# EAGLE board Resistor_Resistor (EAGLE 8.3.0), part 12 of 32
## Placement (x,y rotation side) (continued)
R14257  10K  [0201]  111.91,35.41 0 top
R14258  10K  [0201]  111.91,36.02 0 top
R14259  10K  [0201]  111.91,36.63 0 top
R14260  10K  [0201]  111.91,37.24 0 top
R14261  10K  [0201]  111.91,37.85 0 top
R14262  10K  [0201]  111.91,38.46 0 top
R14263  10K  [0201]  111.91,39.07 0 top
R14264  10K  [0201]  111.91,39.67 0 top
R14265  10K  [0201]  111.91,40.28 0 top
R14266  10K  [0201]  111.91,40.89 0 top
R14267  10K  [0201]  111.91,41.5 0 top
R14268  10K  [0201]  111.91,42.11 0 top
R14269  10K  [0201]  111.91,42.72 0 top
R14270  10K  [0201]  111.91,43.33 0 top
R14271  10K  [0201]  111.91,43.94 0 top
R14272  10K  [0201]  111.91,44.55 0 top
R14273  10K  [0201]  111.91,45.16 0 top
R14274  10K  [0201]  111.91,45.77 0 top
R14275  10K  [0201]  111.91,46.38 0 top
R14276  10K  [0201]  111.91,46.99 0 top
R14277  10K  [0201]  111.91,47.6 0 top
R14278  10K  [0201]  111.91,48.21 0 top
R14279  10K  [0201]  111.91,48.82 0 top
R14280  10K  [0201]  111.91,49.43 0 top
R14281  10K  [0201]  111.91,50.04 0 top
R14282  10K  [0201]  111.91,50.65 0 top
R14283  10K  [0201]  111.91,51.26 0 top
R14284  10K  [0201]  111.91,51.87 0 top
R14285  10K  [0201]  111.91,52.48 0 top
R14286  10K  [0201]  111.91,53.09 0 top
R14287  10K  [0201]  111.91,53.7 0 top
R14288  10K  [0201]  111.91,54.31 0 top
R14289  10K  [0201]  111.91,54.91 0 top
R14290  10K  [0201]  111.91,55.52 0 top
R14291  10K  [0201]  111.91,56.13 0 top
R14292  10K  [0201]  111.91,56.74 0 top
R14293  10K  [0201]  111.91,57.35 0 top
R14294  10K  [0201]  111.91,57.96 0 top
R14295  10K  [0201]  111.91,58.57 0 top
R14296  10K  [0201]  111.91,59.18 0 top
R14297  10K  [0201]  111.91,59.79 0 top
R14298  10K  [0201]  111.91,60.4 0 top
R14299  10K  [0201]  111.91,61.01 0 top
R14300  10K  [0201]  111.91,61.62 0 top
R14301  10K  [0201]  111.91,62.23 0 top
R14302  10K  [0201]  111.91,62.84 0 top
R14303  10K  [0201]  111.91,63.45 0 top
R14304  10K  [0201]  111.91,64.06 0 top
R14305  10K  [0201]  111.91,64.67 0 top
R14306  10K  [0201]  111.91,65.28 0 top
R14307  10K  [0201]  111.91,65.89 0 top
R14308  10K  [0201]  111.91,66.5 0 top
R14309  10K  [0201]  111.91,67.11 0 top
R14310  10K  [0201]  111.91,67.72 0 top
R14311  10K  [0201]  111.91,68.33 0 top
R14312  10K  [0201]  111.91,68.94 0 top
R14313  10K  [0201]  111.91,69.55 0 top
R14314  10K  [0201]  111.91,70.15 0 top
R14315  10K  [0201]  111.91,70.76 0 top
R14316  10K  [0201]  111.91,71.37 0 top
R14317  10K  [0201]  111.91,71.98 0 top
R14318  10K  [0201]  111.91,72.59 0 top
R14319  10K  [0201]  111.91,73.2 0 top
R14320  10K  [0201]  111.91,73.81 0 top
R14321  10K  [0201]  111.91,74.42 0 top
R14322  10K  [0201]  111.91,75.03 0 top
R14323  10K  [0201]  111.91,75.64 0 top
R14324  10K  [0201]  111.91,76.25 0 top
R14325  10K  [0201]  111.91,76.86 0 top
R14326  10K  [0201]  111.91,77.47 0 top
R14327  10K  [0201]  111.91,78.08 0 top
R14328  10K  [0201]  111.91,78.69 0 top
R14329  10K  [0201]  111.91,79.3 0 top
R14330  10K  [0201]  111.91,79.91 0 top
R14331  10K  [0201]  111.91,80.52 0 top
R14332  10K  [0201]  111.91,81.13 0 top
R14333  10K  [0201]  111.91,81.74 0 top
R14334  10K  [0201]  111.91,82.35 0 top
R14335  10K  [0201]  111.91,82.96 0 top
R14336  10K  [0201]  111.91,83.57 0 top
R14337  10K  [0201]  111.91,84.18 0 top
R14338  10K  [0201]  111.91,84.79 0 top
R14339  10K  [0201]  111.91,85.39 0 top
R14340  10K  [0201]  111.91,86 0 top
R14341  10K  [0201]  111.91,86.61 0 top
R14342  10K  [0201]  111.91,87.22 0 top
R14343  10K  [0201]  111.91,87.83 0 top
R14344  10K  [0201]  111.91,88.44 0 top
R14345  10K  [0201]  111.91,89.05 0 top
R14346  10K  [0201]  111.91,89.66 0 top
R14347  10K  [0201]  111.91,90.27 0 top
R14348  10K  [0201]  111.91,90.88 0 top
R14349  10K  [0201]  111.91,91.49 0 top
R14350  10K  [0201]  111.91,92.1 0 top
R14351  10K  [0201]  111.91,92.71 0 top
R14352  10K  [0201]  111.91,93.32 0 top
R14353  10K  [0201]  111.91,93.93 0 top
R14354  10K  [0201]  111.91,94.54 0 top
R14355  10K  [0201]  111.91,95.15 0 top
R14356  10K  [0201]  111.91,95.76 0 top
R14357  10K  [0201]  111.91,96.37 0 top
R14358  10K  [0201]  111.91,96.98 0 top
R14359  10K  [0201]  111.91,97.59 0 top
R14360  10K  [0201]  111.91,98.2 0 top
R14361  10K  [0201]  111.91,98.81 0 top
R14362  10K  [0201]  111.91,99.42 0 top
R14363  10K  [0201]  111.91,100.03 0 top
R14364  10K  [0201]  111.91,100.63 0 top
R14365  10K  [0201]  111.91,101.24 0 top
R14366  10K  [0201]  111.91,101.85 0 top
R14367  10K  [0201]  111.91,102.46 0 top
R14368  10K  [0201]  111.91,103.07 0 top
R14369  10K  [0201]  111.91,103.68 0 top
R14370  10K  [0201]  111.91,104.29 0 top
R14371  10K  [0201]  111.91,104.9 0 top
R14372  10K  [0201]  111.91,105.51 0 top
R14373  10K  [0201]  111.91,106.12 0 top
R14374  10K  [0201]  111.91,106.73 0 top
R14375  10K  [0201]  111.91,107.34 0 top
R14376  10K  [0201]  111.91,107.95 0 top
R14377  10K  [0201]  111.91,108.56 0 top
R14378  10K  [0201]  111.91,109.17 0 top
R14379  10K  [0201]  111.91,109.78 0 top
R14380  10K  [0201]  111.91,110.39 0 top
R14381  10K  [0201]  111.91,111 0 top
R14382  10K  [0201]  111.91,111.61 0 top
R14383  10K  [0201]  111.91,112.22 0 top
R14384  10K  [0201]  111.91,112.83 0 top
R14385  10K  [0201]  111.91,113.44 0 top
R14386  10K  [0201]  111.91,114.05 0 top
R14387  10K  [0201]  111.91,114.66 0 top
R14388  10K  [0201]  111.91,115.27 0 top
R14389  10K  [0201]  111.91,115.87 0 top
R14390  10K  [0201]  111.91,116.48 0 top
R14391  10K  [0201]  111.91,117.09 0 top
R14392  10K  [0201]  111.91,117.7 0 top
R14393  10K  [0201]  111.91,118.31 0 top
R14394  10K  [0201]  111.91,118.92 0 top
R14395  10K  [0201]  111.91,119.53 0 top
R14396  10K  [0201]  111.91,120.14 0 top
R14397  10K  [0201]  111.91,120.75 0 top
R14398  10K  [0201]  111.91,121.36 0 top
R14399  10K  [0201]  111.91,121.97 0 top
R14400  10K  [0201]  111.91,122.58 0 top
R14401  10K  [0201]  113.13,1.27 0 top
R14402  10K  [0201]  113.13,1.88 0 top
R14403  10K  [0201]  113.13,2.49 0 top
R14404  10K  [0201]  113.13,3.1 0 top
R14405  10K  [0201]  113.13,3.71 0 top
R14406  10K  [0201]  113.13,4.32 0 top
R14407  10K  [0201]  113.13,4.93 0 top
R14408  10K  [0201]  113.13,5.54 0 top
R14409  10K  [0201]  113.13,6.15 0 top
R14410  10K  [0201]  113.13,6.76 0 top
R14411  10K  [0201]  113.13,7.37 0 top
R14412  10K  [0201]  113.13,7.98 0 top
R14413  10K  [0201]  113.13,8.59 0 top
R14414  10K  [0201]  113.13,9.19 0 top
R14415  10K  [0201]  113.13,9.8 0 top
R14416  10K  [0201]  113.13,10.41 0 top
R14417  10K  [0201]  113.13,11.02 0 top
R14418  10K  [0201]  113.13,11.63 0 top
R14419  10K  [0201]  113.13,12.24 0 top
R14420  10K  [0201]  113.13,12.85 0 top
R14421  10K  [0201]  113.13,13.46 0 top
R14422  10K  [0201]  113.13,14.07 0 top
R14423  10K  [0201]  113.13,14.68 0 top
R14424  10K  [0201]  113.13,15.29 0 top
R14425  10K  [0201]  113.13,15.9 0 top
R14426  10K  [0201]  113.13,16.51 0 top
R14427  10K  [0201]  113.13,17.12 0 top
R14428  10K  [0201]  113.13,17.73 0 top
R14429  10K  [0201]  113.13,18.34 0 top
R14430  10K  [0201]  113.13,18.95 0 top
R14431  10K  [0201]  113.13,19.56 0 top
R14432  10K  [0201]  113.13,20.17 0 top
R14433  10K  [0201]  113.13,20.78 0 top
R14434  10K  [0201]  113.13,21.39 0 top
R14435  10K  [0201]  113.13,22 0 top
R14436  10K  [0201]  113.13,22.61 0 top
R14437  10K  [0201]  113.13,23.22 0 top
R14438  10K  [0201]  113.13,23.83 0 top
R14439  10K  [0201]  113.13,24.43 0 top
R14440  10K  [0201]  113.13,25.04 0 top
R14441  10K  [0201]  113.13,25.65 0 top
R14442  10K  [0201]  113.13,26.26 0 top
R14443  10K  [0201]  113.13,26.87 0 top
R14444  10K  [0201]  113.13,27.48 0 top
R14445  10K  [0201]  113.13,28.09 0 top
R14446  10K  [0201]  113.13,28.7 0 top
R14447  10K  [0201]  113.13,29.31 0 top
R14448  10K  [0201]  113.13,29.92 0 top
R14449  10K  [0201]  113.13,30.53 0 top
R14450  10K  [0201]  113.13,31.14 0 top
R14451  10K  [0201]  113.13,31.75 0 top
R14452  10K  [0201]  113.13,32.36 0 top
R14453  10K  [0201]  113.13,32.97 0 top
R14454  10K  [0201]  113.13,33.58 0 top
R14455  10K  [0201]  113.13,34.19 0 top
R14456  10K  [0201]  113.13,34.8 0 top
R14457  10K  [0201]  113.13,35.41 0 top
R14458  10K  [0201]  113.13,36.02 0 top
R14459  10K  [0201]  113.13,36.63 0 top
R14460  10K  [0201]  113.13,37.24 0 top
R14461  10K  [0201]  113.13,37.85 0 top
R14462  10K  [0201]  113.13,38.46 0 top
R14463  10K  [0201]  113.13,39.07 0 top
R14464  10K  [0201]  113.13,39.67 0 top
R14465  10K  [0201]  113.13,40.28 0 top
R14466  10K  [0201]  113.13,40.89 0 top
R14467  10K  [0201]  113.13,41.5 0 top
R14468  10K  [0201]  113.13,42.11 0 top
R14469  10K  [0201]  113.13,42.72 0 top
R14470  10K  [0201]  113.13,43.33 0 top
R14471  10K  [0201]  113.13,43.94 0 top
R14472  10K  [0201]  113.13,44.55 0 top
R14473  10K  [0201]  113.13,45.16 0 top
R14474  10K  [0201]  113.13,45.77 0 top
R14475  10K  [0201]  113.13,46.38 0 top
R14476  10K  [0201]  113.13,46.99 0 top
R14477  10K  [0201]  113.13,47.6 0 top
R14478  10K  [0201]  113.13,48.21 0 top
R14479  10K  [0201]  113.13,48.82 0 top
R14480  10K  [0201]  113.13,49.43 0 top
R14481  10K  [0201]  113.13,50.04 0 top
R14482  10K  [0201]  113.13,50.65 0 top
R14483  10K  [0201]  113.13,51.26 0 top
R14484  10K  [0201]  113.13,51.87 0 top
R14485  10K  [0201]  113.13,52.48 0 top
R14486  10K  [0201]  113.13,53.09 0 top
R14487  10K  [0201]  113.13,53.7 0 top
R14488  10K  [0201]  113.13,54.31 0 top
R14489  10K  [0201]  113.13,54.91 0 top
R14490  10K  [0201]  113.13,55.52 0 top
R14491  10K  [0201]  113.13,56.13 0 top
R14492  10K  [0201]  113.13,56.74 0 top
R14493  10K  [0201]  113.13,57.35 0 top
R14494  10K  [0201]  113.13,57.96 0 top
R14495  10K  [0201]  113.13,58.57 0 top
R14496  10K  [0201]  113.13,59.18 0 top
R14497  10K  [0201]  113.13,59.79 0 top
R14498  10K  [0201]  113.13,60.4 0 top
R14499  10K  [0201]  113.13,61.01 0 top
R14500  10K  [0201]  113.13,61.62 0 top
R14501  10K  [0201]  113.13,62.23 0 top
R14502  10K  [0201]  113.13,62.84 0 top
R14503  10K  [0201]  113.13,63.45 0 top
R14504  10K  [0201]  113.13,64.06 0 top
R14505  10K  [0201]  113.13,64.67 0 top
R14506  10K  [0201]  113.13,65.28 0 top
R14507  10K  [0201]  113.13,65.89 0 top
R14508  10K  [0201]  113.13,66.5 0 top
R14509  10K  [0201]  113.13,67.11 0 top
R14510  10K  [0201]  113.13,67.72 0 top
R14511  10K  [0201]  113.13,68.33 0 top
R14512  10K  [0201]  113.13,68.94 0 top
R14513  10K  [0201]  113.13,69.55 0 top
R14514  10K  [0201]  113.13,70.15 0 top
R14515  10K  [0201]  113.13,70.76 0 top
R14516  10K  [0201]  113.13,71.37 0 top
R14517  10K  [0201]  113.13,71.98 0 top
R14518  10K  [0201]  113.13,72.59 0 top
R14519  10K  [0201]  113.13,73.2 0 top
R14520  10K  [0201]  113.13,73.81 0 top
R14521  10K  [0201]  113.13,74.42 0 top
R14522  10K  [0201]  113.13,75.03 0 top
R14523  10K  [0201]  113.13,75.64 0 top
R14524  10K  [0201]  113.13,76.25 0 top
R14525  10K  [0201]  113.13,76.86 0 top
R14526  10K  [0201]  113.13,77.47 0 top
R14527  10K  [0201]  113.13,78.08 0 top
R14528  10K  [0201]  113.13,78.69 0 top
R14529  10K  [0201]  113.13,79.3 0 top
R14530  10K  [0201]  113.13,79.91 0 top
R14531  10K  [0201]  113.13,80.52 0 top
R14532  10K  [0201]  113.13,81.13 0 top
R14533  10K  [0201]  113.13,81.74 0 top
R14534  10K  [0201]  113.13,82.35 0 top
R14535  10K  [0201]  113.13,82.96 0 top
R14536  10K  [0201]  113.13,83.57 0 top
R14537  10K  [0201]  113.13,84.18 0 top
R14538  10K  [0201]  113.13,84.79 0 top
R14539  10K  [0201]  113.13,85.39 0 top
R14540  10K  [0201]  113.13,86 0 top
R14541  10K  [0201]  113.13,86.61 0 top
R14542  10K  [0201]  113.13,87.22 0 top
R14543  10K  [0201]  113.13,87.83 0 top
R14544  10K  [0201]  113.13,88.44 0 top
R14545  10K  [0201]  113.13,89.05 0 top
R14546  10K  [0201]  113.13,89.66 0 top
R14547  10K  [0201]  113.13,90.27 0 top
R14548  10K  [0201]  113.13,90.88 0 top
R14549  10K  [0201]  113.13,91.49 0 top
R14550  10K  [0201]  113.13,92.1 0 top
R14551  10K  [0201]  113.13,92.71 0 top
R14552  10K  [0201]  113.13,93.32 0 top
R14553  10K  [0201]  113.13,93.93 0 top
R14554  10K  [0201]  113.13,94.54 0 top
R14555  10K  [0201]  113.13,95.15 0 top
R14556  10K  [0201]  113.13,95.76 0 top
R14557  10K  [0201]  113.13,96.37 0 top
R14558  10K  [0201]  113.13,96.98 0 top
R14559  10K  [0201]  113.13,97.59 0 top
R14560  10K  [0201]  113.13,98.2 0 top
R14561  10K  [0201]  113.13,98.81 0 top
R14562  10K  [0201]  113.13,99.42 0 top
R14563  10K  [0201]  113.13,100.03 0 top
R14564  10K  [0201]  113.13,100.63 0 top
R14565  10K  [0201]  113.13,101.24 0 top
R14566  10K  [0201]  113.13,101.85 0 top
R14567  10K  [0201]  113.13,102.46 0 top
R14568  10K  [0201]  113.13,103.07 0 top
R14569  10K  [0201]  113.13,103.68 0 top
R14570  10K  [0201]  113.13,104.29 0 top
R14571  10K  [0201]  113.13,104.9 0 top
R14572  10K  [0201]  113.13,105.51 0 top
R14573  10K  [0201]  113.13,106.12 0 top
R14574  10K  [0201]  113.13,106.73 0 top
R14575  10K  [0201]  113.13,107.34 0 top
R14576  10K  [0201]  113.13,107.95 0 top
R14577  10K  [0201]  113.13,108.56 0 top
R14578  10K  [0201]  113.13,109.17 0 top
R14579  10K  [0201]  113.13,109.78 0 top
R14580  10K  [0201]  113.13,110.39 0 top
R14581  10K  [0201]  113.13,111 0 top
R14582  10K  [0201]  113.13,111.61 0 top
R14583  10K  [0201]  113.13,112.22 0 top
R14584  10K  [0201]  113.13,112.83 0 top
R14585  10K  [0201]  113.13,113.44 0 top
R14586  10K  [0201]  113.13,114.05 0 top
R14587  10K  [0201]  113.13,114.66 0 top
R14588  10K  [0201]  113.13,115.27 0 top
R14589  10K  [0201]  113.13,115.87 0 top
R14590  10K  [0201]  113.13,116.48 0 top
R14591  10K  [0201]  113.13,117.09 0 top
R14592  10K  [0201]  113.13,117.7 0 top
R14593  10K  [0201]  113.13,118.31 0 top
R14594  10K  [0201]  113.13,118.92 0 top
R14595  10K  [0201]  113.13,119.53 0 top
R14596  10K  [0201]  113.13,120.14 0 top
R14597  10K  [0201]  113.13,120.75 0 top
R14598  10K  [0201]  113.13,121.36 0 top
R14599  10K  [0201]  113.13,121.97 0 top
R14600  10K  [0201]  113.13,122.58 0 top
R14601  10K  [0201]  114.35,1.27 0 top
R14602  10K  [0201]  114.35,1.88 0 top
R14603  10K  [0201]  114.35,2.49 0 top
R14604  10K  [0201]  114.35,3.1 0 top
R14605  10K  [0201]  114.35,3.71 0 top
R14606  10K  [0201]  114.35,4.32 0 top
R14607  10K  [0201]  114.35,4.93 0 top
R14608  10K  [0201]  114.35,5.54 0 top
R14609  10K  [0201]  114.35,6.15 0 top
R14610  10K  [0201]  114.35,6.76 0 top
R14611  10K  [0201]  114.35,7.37 0 top
R14612  10K  [0201]  114.35,7.98 0 top
R14613  10K  [0201]  114.35,8.59 0 top
R14614  10K  [0201]  114.35,9.19 0 top
R14615  10K  [0201]  114.35,9.8 0 top
R14616  10K  [0201]  114.35,10.41 0 top
R14617  10K  [0201]  114.35,11.02 0 top
R14618  10K  [0201]  114.35,11.63 0 top
R14619  10K  [0201]  114.35,12.24 0 top
R14620  10K  [0201]  114.35,12.85 0 top
R14621  10K  [0201]  114.35,13.46 0 top
R14622  10K  [0201]  114.35,14.07 0 top
R14623  10K  [0201]  114.35,14.68 0 top
R14624  10K  [0201]  114.35,15.29 0 top
R14625  10K  [0201]  114.35,15.9 0 top
R14626  10K  [0201]  114.35,16.51 0 top
R14627  10K  [0201]  114.35,17.12 0 top
R14628  10K  [0201]  114.35,17.73 0 top
R14629  10K  [0201]  114.35,18.34 0 top
R14630  10K  [0201]  114.35,18.95 0 top
R14631  10K  [0201]  114.35,19.56 0 top
R14632  10K  [0201]  114.35,20.17 0 top
R14633  10K  [0201]  114.35,20.78 0 top
R14634  10K  [0201]  114.35,21.39 0 top
R14635  10K  [0201]  114.35,22 0 top
R14636  10K  [0201]  114.35,22.61 0 top
R14637  10K  [0201]  114.35,23.22 0 top
R14638  10K  [0201]  114.35,23.83 0 top
R14639  10K  [0201]  114.35,24.43 0 top
R14640  10K  [0201]  114.35,25.04 0 top
R14641  10K  [0201]  114.35,25.65 0 top
R14642  10K  [0201]  114.35,26.26 0 top
R14643  10K  [0201]  114.35,26.87 0 top
R14644  10K  [0201]  114.35,27.48 0 top
R14645  10K  [0201]  114.35,28.09 0 top
R14646  10K  [0201]  114.35,28.7 0 top
R14647  10K  [0201]  114.35,29.31 0 top
R14648  10K  [0201]  114.35,29.92 0 top
R14649  10K  [0201]  114.35,30.53 0 top
R14650  10K  [0201]  114.35,31.14 0 top
R14651  10K  [0201]  114.35,31.75 0 top
R14652  10K  [0201]  114.35,32.36 0 top
R14653  10K  [0201]  114.35,32.97 0 top
R14654  10K  [0201]  114.35,33.58 0 top
R14655  10K  [0201]  114.35,34.19 0 top
R14656  10K  [0201]  114.35,34.8 0 top
R14657  10K  [0201]  114.35,35.41 0 top
R14658  10K  [0201]  114.35,36.02 0 top
R14659  10K  [0201]  114.35,36.63 0 top
R14660  10K  [0201]  114.35,37.24 0 top
R14661  10K  [0201]  114.35,37.85 0 top
R14662  10K  [0201]  114.35,38.46 0 top
R14663  10K  [0201]  114.35,39.07 0 top
R14664  10K  [0201]  114.35,39.67 0 top
R14665  10K  [0201]  114.35,40.28 0 top
R14666  10K  [0201]  114.35,40.89 0 top
R14667  10K  [0201]  114.35,41.5 0 top
R14668  10K  [0201]  114.35,42.11 0 top
R14669  10K  [0201]  114.35,42.72 0 top
R14670  10K  [0201]  114.35,43.33 0 top
R14671  10K  [0201]  114.35,43.94 0 top
R14672  10K  [0201]  114.35,44.55 0 top
R14673  10K  [0201]  114.35,45.16 0 top
R14674  10K  [0201]  114.35,45.77 0 top
R14675  10K  [0201]  114.35,46.38 0 top
R14676  10K  [0201]  114.35,46.99 0 top
R14677  10K  [0201]  114.35,47.6 0 top
R14678  10K  [0201]  114.35,48.21 0 top
R14679  10K  [0201]  114.35,48.82 0 top
R14680  10K  [0201]  114.35,49.43 0 top
R14681  10K  [0201]  114.35,50.04 0 top
R14682  10K  [0201]  114.35,50.65 0 top
R14683  10K  [0201]  114.35,51.26 0 top
R14684  10K  [0201]  114.35,51.87 0 top
R14685  10K  [0201]  114.35,52.48 0 top
R14686  10K  [0201]  114.35,53.09 0 top
R14687  10K  [0201]  114.35,53.7 0 top
R14688  10K  [0201]  114.35,54.31 0 top
R14689  10K  [0201]  114.35,54.91 0 top
R14690  10K  [0201]  114.35,55.52 0 top
R14691  10K  [0201]  114.35,56.13 0 top
R14692  10K  [0201]  114.35,56.74 0 top
R14693  10K  [0201]  114.35,57.35 0 top
R14694  10K  [0201]  114.35,57.96 0 top
R14695  10K  [0201]  114.35,58.57 0 top
R14696  10K  [0201]  114.35,59.18 0 top
R14697  10K  [0201]  114.35,59.79 0 top
R14698  10K  [0201]  114.35,60.4 0 top
R14699  10K  [0201]  114.35,61.01 0 top
R14700  10K  [0201]  114.35,61.62 0 top
R14701  10K  [0201]  114.35,62.23 0 top
R14702  10K  [0201]  114.35,62.84 0 top
R14703  10K  [0201]  114.35,63.45 0 top
R14704  10K  [0201]  114.35,64.06 0 top
R14705  10K  [0201]  114.35,64.67 0 top
R14706  10K  [0201]  114.35,65.28 0 top
R14707  10K  [0201]  114.35,65.89 0 top
R14708  10K  [0201]  114.35,66.5 0 top
R14709  10K  [0201]  114.35,67.11 0 top
R14710  10K  [0201]  114.35,67.72 0 top
R14711  10K  [0201]  114.35,68.33 0 top
R14712  10K  [0201]  114.35,68.94 0 top
R14713  10K  [0201]  114.35,69.55 0 top
R14714  10K  [0201]  114.35,70.15 0 top
R14715  10K  [0201]  114.35,70.76 0 top
R14716  10K  [0201]  114.35,71.37 0 top
R14717  10K  [0201]  114.35,71.98 0 top
R14718  10K  [0201]  114.35,72.59 0 top
R14719  10K  [0201]  114.35,73.2 0 top
R14720  10K  [0201]  114.35,73.81 0 top
R14721  10K  [0201]  114.35,74.42 0 top
R14722  10K  [0201]  114.35,75.03 0 top
R14723  10K  [0201]  114.35,75.64 0 top
R14724  10K  [0201]  114.35,76.25 0 top
R14725  10K  [0201]  114.35,76.86 0 top
R14726  10K  [0201]  114.35,77.47 0 top
R14727  10K  [0201]  114.35,78.08 0 top
R14728  10K  [0201]  114.35,78.69 0 top
R14729  10K  [0201]  114.35,79.3 0 top
R14730  10K  [0201]  114.35,79.91 0 top
R14731  10K  [0201]  114.35,80.52 0 top
R14732  10K  [0201]  114.35,81.13 0 top
R14733  10K  [0201]  114.35,81.74 0 top
R14734  10K  [0201]  114.35,82.35 0 top
R14735  10K  [0201]  114.35,82.96 0 top
R14736  10K  [0201]  114.35,83.57 0 top
R14737  10K  [0201]  114.35,84.18 0 top
R14738  10K  [0201]  114.35,84.79 0 top
R14739  10K  [0201]  114.35,85.39 0 top
R14740  10K  [0201]  114.35,86 0 top
R14741  10K  [0201]  114.35,86.61 0 top
R14742  10K  [0201]  114.35,87.22 0 top
R14743  10K  [0201]  114.35,87.83 0 top
R14744  10K  [0201]  114.35,88.44 0 top
R14745  10K  [0201]  114.35,89.05 0 top
R14746  10K  [0201]  114.35,89.66 0 top
R14747  10K  [0201]  114.35,90.27 0 top
R14748  10K  [0201]  114.35,90.88 0 top
R14749  10K  [0201]  114.35,91.49 0 top
R14750  10K  [0201]  114.35,92.1 0 top
R14751  10K  [0201]  114.35,92.71 0 top
R14752  10K  [0201]  114.35,93.32 0 top
R14753  10K  [0201]  114.35,93.93 0 top
R14754  10K  [0201]  114.35,94.54 0 top
R14755  10K  [0201]  114.35,95.15 0 top
R14756  10K  [0201]  114.35,95.76 0 top
R14757  10K  [0201]  114.35,96.37 0 top
R14758  10K  [0201]  114.35,96.98 0 top
R14759  10K  [0201]  114.35,97.59 0 top
R14760  10K  [0201]  114.35,98.2 0 top
R14761  10K  [0201]  114.35,98.81 0 top
R14762  10K  [0201]  114.35,99.42 0 top
R14763  10K  [0201]  114.35,100.03 0 top
R14764  10K  [0201]  114.35,100.63 0 top
R14765  10K  [0201]  114.35,101.24 0 top
R14766  10K  [0201]  114.35,101.85 0 top
R14767  10K  [0201]  114.35,102.46 0 top
R14768  10K  [0201]  114.35,103.07 0 top
R14769  10K  [0201]  114.35,103.68 0 top
R14770  10K  [0201]  114.35,104.29 0 top
R14771  10K  [0201]  114.35,104.9 0 top
R14772  10K  [0201]  114.35,105.51 0 top
R14773  10K  [0201]  114.35,106.12 0 top
R14774  10K  [0201]  114.35,106.73 0 top
R14775  10K  [0201]  114.35,107.34 0 top
R14776  10K  [0201]  114.35,107.95 0 top
R14777  10K  [0201]  114.35,108.56 0 top
R14778  10K  [0201]  114.35,109.17 0 top
R14779  10K  [0201]  114.35,109.78 0 top
R14780  10K  [0201]  114.35,110.39 0 top
R14781  10K  [0201]  114.35,111 0 top
R14782  10K  [0201]  114.35,111.61 0 top
R14783  10K  [0201]  114.35,112.22 0 top
R14784  10K  [0201]  114.35,112.83 0 top
R14785  10K  [0201]  114.35,113.44 0 top
R14786  10K  [0201]  114.35,114.05 0 top
R14787  10K  [0201]  114.35,114.66 0 top
R14788  10K  [0201]  114.35,115.27 0 top
R14789  10K  [0201]  114.35,115.87 0 top
R14790  10K  [0201]  114.35,116.48 0 top
R14791  10K  [0201]  114.35,117.09 0 top
R14792  10K  [0201]  114.35,117.7 0 top
R14793  10K  [0201]  114.35,118.31 0 top
R14794  10K  [0201]  114.35,118.92 0 top
R14795  10K  [0201]  114.35,119.53 0 top
R14796  10K  [0201]  114.35,120.14 0 top
R14797  10K  [0201]  114.35,120.75 0 top
R14798  10K  [0201]  114.35,121.36 0 top
R14799  10K  [0201]  114.35,121.97 0 top
R14800  10K  [0201]  114.35,122.58 0 top
R14801  10K  [0201]  115.57,1.27 0 top
R14802  10K  [0201]  115.57,1.88 0 top
R14803  10K  [0201]  115.57,2.49 0 top
R14804  10K  [0201]  115.57,3.1 0 top
R14805  10K  [0201]  115.57,3.71 0 top
R14806  10K  [0201]  115.57,4.32 0 top
R14807  10K  [0201]  115.57,4.93 0 top
R14808  10K  [0201]  115.57,5.54 0 top
R14809  10K  [0201]  115.57,6.15 0 top
R14810  10K  [0201]  115.57,6.76 0 top
R14811  10K  [0201]  115.57,7.37 0 top
R14812  10K  [0201]  115.57,7.98 0 top
R14813  10K  [0201]  115.57,8.59 0 top
R14814  10K  [0201]  115.57,9.19 0 top
R14815  10K  [0201]  115.57,9.8 0 top
R14816  10K  [0201]  115.57,10.41 0 top
R14817  10K  [0201]  115.57,11.02 0 top
R14818  10K  [0201]  115.57,11.63 0 top
R14819  10K  [0201]  115.57,12.24 0 top
R14820  10K  [0201]  115.57,12.85 0 top
R14821  10K  [0201]  115.57,13.46 0 top
R14822  10K  [0201]  115.57,14.07 0 top
R14823  10K  [0201]  115.57,14.68 0 top
R14824  10K  [0201]  115.57,15.29 0 top
R14825  10K  [0201]  115.57,15.9 0 top
R14826  10K  [0201]  115.57,16.51 0 top
R14827  10K  [0201]  115.57,17.12 0 top
R14828  10K  [0201]  115.57,17.73 0 top
R14829  10K  [0201]  115.57,18.34 0 top
R14830  10K  [0201]  115.57,18.95 0 top
R14831  10K  [0201]  115.57,19.56 0 top
R14832  10K  [0201]  115.57,20.17 0 top
R14833  10K  [0201]  115.57,20.78 0 top
R14834  10K  [0201]  115.57,21.39 0 top
R14835  10K  [0201]  115.57,22 0 top
R14836  10K  [0201]  115.57,22.61 0 top
R14837  10K  [0201]  115.57,23.22 0 top
R14838  10K  [0201]  115.57,23.83 0 top
R14839  10K  [0201]  115.57,24.43 0 top
R14840  10K  [0201]  115.57,25.04 0 top
R14841  10K  [0201]  115.57,25.65 0 top
R14842  10K  [0201]  115.57,26.26 0 top
R14843  10K  [0201]  115.57,26.87 0 top
R14844  10K  [0201]  115.57,27.48 0 top
R14845  10K  [0201]  115.57,28.09 0 top
R14846  10K  [0201]  115.57,28.7 0 top
R14847  10K  [0201]  115.57,29.31 0 top
R14848  10K  [0201]  115.57,29.92 0 top
R14849  10K  [0201]  115.57,30.53 0 top
R14850  10K  [0201]  115.57,31.14 0 top
R14851  10K  [0201]  115.57,31.75 0 top
R14852  10K  [0201]  115.57,32.36 0 top
R14853  10K  [0201]  115.57,32.97 0 top
R14854  10K  [0201]  115.57,33.58 0 top
R14855  10K  [0201]  115.57,34.19 0 top
R14856  10K  [0201]  115.57,34.8 0 top
R14857  10K  [0201]  115.57,35.41 0 top
R14858  10K  [0201]  115.57,36.02 0 top
R14859  10K  [0201]  115.57,36.63 0 top
R14860  10K  [0201]  115.57,37.24 0 top
R14861  10K  [0201]  115.57,37.85 0 top
R14862  10K  [0201]  115.57,38.46 0 top
R14863  10K  [0201]  115.57,39.07 0 top
R14864  10K  [0201]  115.57,39.67 0 top
R14865  10K  [0201]  115.57,40.28 0 top
R14866  10K  [0201]  115.57,40.89 0 top
R14867  10K  [0201]  115.57,41.5 0 top
R14868  10K  [0201]  115.57,42.11 0 top
R14869  10K  [0201]  115.57,42.72 0 top
R14870  10K  [0201]  115.57,43.33 0 top
R14871  10K  [0201]  115.57,43.94 0 top
R14872  10K  [0201]  115.57,44.55 0 top
R14873  10K  [0201]  115.57,45.16 0 top
R14874  10K  [0201]  115.57,45.77 0 top
R14875  10K  [0201]  115.57,46.38 0 top
R14876  10K  [0201]  115.57,46.99 0 top
R14877  10K  [0201]  115.57,47.6 0 top
R14878  10K  [0201]  115.57,48.21 0 top
R14879  10K  [0201]  115.57,48.82 0 top
R14880  10K  [0201]  115.57,49.43 0 top
R14881  10K  [0201]  115.57,50.04 0 top
R14882  10K  [0201]  115.57,50.65 0 top
R14883  10K  [0201]  115.57,51.26 0 top
R14884  10K  [0201]  115.57,51.87 0 top
R14885  10K  [0201]  115.57,52.48 0 top
R14886  10K  [0201]  115.57,53.09 0 top
R14887  10K  [0201]  115.57,53.7 0 top
R14888  10K  [0201]  115.57,54.31 0 top
R14889  10K  [0201]  115.57,54.91 0 top
R14890  10K  [0201]  115.57,55.52 0 top
R14891  10K  [0201]  115.57,56.13 0 top
R14892  10K  [0201]  115.57,56.74 0 top
R14893  10K  [0201]  115.57,57.35 0 top
R14894  10K  [0201]  115.57,57.96 0 top
R14895  10K  [0201]  115.57,58.57 0 top
R14896  10K  [0201]  115.57,59.18 0 top
R14897  10K  [0201]  115.57,59.79 0 top
R14898  10K  [0201]  115.57,60.4 0 top
R14899  10K  [0201]  115.57,61.01 0 top
R14900  10K  [0201]  115.57,61.62 0 top
R14901  10K  [0201]  115.57,62.23 0 top
R14902  10K  [0201]  115.57,62.84 0 top
R14903  10K  [0201]  115.57,63.45 0 top
R14904  10K  [0201]  115.57,64.06 0 top
R14905  10K  [0201]  115.57,64.67 0 top
R14906  10K  [0201]  115.57,65.28 0 top
R14907  10K  [0201]  115.57,65.89 0 top
R14908  10K  [0201]  115.57,66.5 0 top
R14909  10K  [0201]  115.57,67.11 0 top
R14910  10K  [0201]  115.57,67.72 0 top
R14911  10K  [0201]  115.57,68.33 0 top
R14912  10K  [0201]  115.57,68.94 0 top
R14913  10K  [0201]  115.57,69.55 0 top
R14914  10K  [0201]  115.57,70.15 0 top
R14915  10K  [0201]  115.57,70.76 0 top
R14916  10K  [0201]  115.57,71.37 0 top
R14917  10K  [0201]  115.57,71.98 0 top
R14918  10K  [0201]  115.57,72.59 0 top
R14919  10K  [0201]  115.57,73.2 0 top
R14920  10K  [0201]  115.57,73.81 0 top
R14921  10K  [0201]  115.57,74.42 0 top
R14922  10K  [0201]  115.57,75.03 0 top
R14923  10K  [0201]  115.57,75.64 0 top
R14924  10K  [0201]  115.57,76.25 0 top
R14925  10K  [0201]  115.57,76.86 0 top
R14926  10K  [0201]  115.57,77.47 0 top
R14927  10K  [0201]  115.57,78.08 0 top
R14928  10K  [0201]  115.57,78.69 0 top
R14929  10K  [0201]  115.57,79.3 0 top
R14930  10K  [0201]  115.57,79.91 0 top
R14931  10K  [0201]  115.57,80.52 0 top
R14932  10K  [0201]  115.57,81.13 0 top
R14933  10K  [0201]  115.57,81.74 0 top
R14934  10K  [0201]  115.57,82.35 0 top
R14935  10K  [0201]  115.57,82.96 0 top
R14936  10K  [0201]  115.57,83.57 0 top
R14937  10K  [0201]  115.57,84.18 0 top
R14938  10K  [0201]  115.57,84.79 0 top
R14939  10K  [0201]  115.57,85.39 0 top
R14940  10K  [0201]  115.57,86 0 top
R14941  10K  [0201]  115.57,86.61 0 top
R14942  10K  [0201]  115.57,87.22 0 top
R14943  10K  [0201]  115.57,87.83 0 top
R14944  10K  [0201]  115.57,88.44 0 top
R14945  10K  [0201]  115.57,89.05 0 top
R14946  10K  [0201]  115.57,89.66 0 top
R14947  10K  [0201]  115.57,90.27 0 top
R14948  10K  [0201]  115.57,90.88 0 top
R14949  10K  [0201]  115.57,91.49 0 top
R14950  10K  [0201]  115.57,92.1 0 top
R14951  10K  [0201]  115.57,92.71 0 top
R14952  10K  [0201]  115.57,93.32 0 top
R14953  10K  [0201]  115.57,93.93 0 top
R14954  10K  [0201]  115.57,94.54 0 top
R14955  10K  [0201]  115.57,95.15 0 top
R14956  10K  [0201]  115.57,95.76 0 top
R14957  10K  [0201]  115.57,96.37 0 top
R14958  10K  [0201]  115.57,96.98 0 top
R14959  10K  [0201]  115.57,97.59 0 top
R14960  10K  [0201]  115.57,98.2 0 top
R14961  10K  [0201]  115.57,98.81 0 top
R14962  10K  [0201]  115.57,99.42 0 top
R14963  10K  [0201]  115.57,100.03 0 top
R14964  10K  [0201]  115.57,100.63 0 top
R14965  10K  [0201]  115.57,101.24 0 top
R14966  10K  [0201]  115.57,101.85 0 top
R14967  10K  [0201]  115.57,102.46 0 top
R14968  10K  [0201]  115.57,103.07 0 top
R14969  10K  [0201]  115.57,103.68 0 top
R14970  10K  [0201]  115.57,104.29 0 top
R14971  10K  [0201]  115.57,104.9 0 top
R14972  10K  [0201]  115.57,105.51 0 top
R14973  10K  [0201]  115.57,106.12 0 top
R14974  10K  [0201]  115.57,106.73 0 top
R14975  10K  [0201]  115.57,107.34 0 top
R14976  10K  [0201]  115.57,107.95 0 top
R14977  10K  [0201]  115.57,108.56 0 top
R14978  10K  [0201]  115.57,109.17 0 top
R14979  10K  [0201]  115.57,109.78 0 top
R14980  10K  [0201]  115.57,110.39 0 top
R14981  10K  [0201]  115.57,111 0 top
R14982  10K  [0201]  115.57,111.61 0 top
R14983  10K  [0201]  115.57,112.22 0 top
R14984  10K  [0201]  115.57,112.83 0 top
R14985  10K  [0201]  115.57,113.44 0 top
R14986  10K  [0201]  115.57,114.05 0 top
R14987  10K  [0201]  115.57,114.66 0 top
R14988  10K  [0201]  115.57,115.27 0 top
R14989  10K  [0201]  115.57,115.87 0 top
R14990  10K  [0201]  115.57,116.48 0 top
R14991  10K  [0201]  115.57,117.09 0 top
R14992  10K  [0201]  115.57,117.7 0 top
R14993  10K  [0201]  115.57,118.31 0 top
R14994  10K  [0201]  115.57,118.92 0 top
R14995  10K  [0201]  115.57,119.53 0 top
R14996  10K  [0201]  115.57,120.14 0 top
R14997  10K  [0201]  115.57,120.75 0 top
R14998  10K  [0201]  115.57,121.36 0 top
R14999  10K  [0201]  115.57,121.97 0 top
R15000  10K  [0201]  115.57,122.58 0 top
R15001  10K  [0201]  116.79,1.27 0 top
R15002  10K  [0201]  116.79,1.88 0 top
R15003  10K  [0201]  116.79,2.49 0 top
R15004  10K  [0201]  116.79,3.1 0 top
R15005  10K  [0201]  116.79,3.71 0 top
R15006  10K  [0201]  116.79,4.32 0 top
R15007  10K  [0201]  116.79,4.93 0 top
R15008  10K  [0201]  116.79,5.54 0 top
R15009  10K  [0201]  116.79,6.15 0 top
R15010  10K  [0201]  116.79,6.76 0 top
R15011  10K  [0201]  116.79,7.37 0 top
R15012  10K  [0201]  116.79,7.98 0 top
R15013  10K  [0201]  116.79,8.59 0 top
R15014  10K  [0201]  116.79,9.19 0 top
R15015  10K  [0201]  116.79,9.8 0 top
R15016  10K  [0201]  116.79,10.41 0 top
R15017  10K  [0201]  116.79,11.02 0 top
R15018  10K  [0201]  116.79,11.63 0 top
R15019  10K  [0201]  116.79,12.24 0 top
R15020  10K  [0201]  116.79,12.85 0 top
R15021  10K  [0201]  116.79,13.46 0 top
R15022  10K  [0201]  116.79,14.07 0 top
R15023  10K  [0201]  116.79,14.68 0 top
R15024  10K  [0201]  116.79,15.29 0 top
R15025  10K  [0201]  116.79,15.9 0 top
R15026  10K  [0201]  116.79,16.51 0 top
R15027  10K  [0201]  116.79,17.12 0 top
R15028  10K  [0201]  116.79,17.73 0 top
R15029  10K  [0201]  116.79,18.34 0 top
R15030  10K  [0201]  116.79,18.95 0 top
R15031  10K  [0201]  116.79,19.56 0 top
R15032  10K  [0201]  116.79,20.17 0 top
R15033  10K  [0201]  116.79,20.78 0 top
R15034  10K  [0201]  116.79,21.39 0 top
R15035  10K  [0201]  116.79,22 0 top
R15036  10K  [0201]  116.79,22.61 0 top
R15037  10K  [0201]  116.79,23.22 0 top
R15038  10K  [0201]  116.79,23.83 0 top
R15039  10K  [0201]  116.79,24.43 0 top
R15040  10K  [0201]  116.79,25.04 0 top
R15041  10K  [0201]  116.79,25.65 0 top
R15042  10K  [0201]  116.79,26.26 0 top
R15043  10K  [0201]  116.79,26.87 0 top
R15044  10K  [0201]  116.79,27.48 0 top
R15045  10K  [0201]  116.79,28.09 0 top
R15046  10K  [0201]  116.79,28.7 0 top
R15047  10K  [0201]  116.79,29.31 0 top
R15048  10K  [0201]  116.79,29.92 0 top
R15049  10K  [0201]  116.79,30.53 0 top
R15050  10K  [0201]  116.79,31.14 0 top
R15051  10K  [0201]  116.79,31.75 0 top
R15052  10K  [0201]  116.79,32.36 0 top
R15053  10K  [0201]  116.79,32.97 0 top
R15054  10K  [0201]  116.79,33.58 0 top
R15055  10K  [0201]  116.79,34.19 0 top
R15056  10K  [0201]  116.79,34.8 0 top
R15057  10K  [0201]  116.79,35.41 0 top
R15058  10K  [0201]  116.79,36.02 0 top
R15059  10K  [0201]  116.79,36.63 0 top
R15060  10K  [0201]  116.79,37.24 0 top
R15061  10K  [0201]  116.79,37.85 0 top
R15062  10K  [0201]  116.79,38.46 0 top
R15063  10K  [0201]  116.79,39.07 0 top
R15064  10K  [0201]  116.79,39.67 0 top
R15065  10K  [0201]  116.79,40.28 0 top
R15066  10K  [0201]  116.79,40.89 0 top
R15067  10K  [0201]  116.79,41.5 0 top
R15068  10K  [0201]  116.79,42.11 0 top
R15069  10K  [0201]  116.79,42.72 0 top
R15070  10K  [0201]  116.79,43.33 0 top
R15071  10K  [0201]  116.79,43.94 0 top
R15072  10K  [0201]  116.79,44.55 0 top
R15073  10K  [0201]  116.79,45.16 0 top
R15074  10K  [0201]  116.79,45.77 0 top
R15075  10K  [0201]  116.79,46.38 0 top
R15076  10K  [0201]  116.79,46.99 0 top
R15077  10K  [0201]  116.79,47.6 0 top
R15078  10K  [0201]  116.79,48.21 0 top
R15079  10K  [0201]  116.79,48.82 0 top
R15080  10K  [0201]  116.79,49.43 0 top
R15081  10K  [0201]  116.79,50.04 0 top
R15082  10K  [0201]  116.79,50.65 0 top
R15083  10K  [0201]  116.79,51.26 0 top
R15084  10K  [0201]  116.79,51.87 0 top
R15085  10K  [0201]  116.79,52.48 0 top
R15086  10K  [0201]  116.79,53.09 0 top
R15087  10K  [0201]  116.79,53.7 0 top
R15088  10K  [0201]  116.79,54.31 0 top
R15089  10K  [0201]  116.79,54.91 0 top
R15090  10K  [0201]  116.79,55.52 0 top
R15091  10K  [0201]  116.79,56.13 0 top
R15092  10K  [0201]  116.79,56.74 0 top
R15093  10K  [0201]  116.79,57.35 0 top
R15094  10K  [0201]  116.79,57.96 0 top
R15095  10K  [0201]  116.79,58.57 0 top
R15096  10K  [0201]  116.79,59.18 0 top
R15097  10K  [0201]  116.79,59.79 0 top
R15098  10K  [0201]  116.79,60.4 0 top
R15099  10K  [0201]  116.79,61.01 0 top
R15100  10K  [0201]  116.79,61.62 0 top
R15101  10K  [0201]  116.79,62.23 0 top
R15102  10K  [0201]  116.79,62.84 0 top
R15103  10K  [0201]  116.79,63.45 0 top
R15104  10K  [0201]  116.79,64.06 0 top
R15105  10K  [0201]  116.79,64.67 0 top
R15106  10K  [0201]  116.79,65.28 0 top
R15107  10K  [0201]  116.79,65.89 0 top
R15108  10K  [0201]  116.79,66.5 0 top
R15109  10K  [0201]  116.79,67.11 0 top
R15110  10K  [0201]  116.79,67.72 0 top
R15111  10K  [0201]  116.79,68.33 0 top
R15112  10K  [0201]  116.79,68.94 0 top
R15113  10K  [0201]  116.79,69.55 0 top
R15114  10K  [0201]  116.79,70.15 0 top
R15115  10K  [0201]  116.79,70.76 0 top
R15116  10K  [0201]  116.79,71.37 0 top
R15117  10K  [0201]  116.79,71.98 0 top
R15118  10K  [0201]  116.79,72.59 0 top
R15119  10K  [0201]  116.79,73.2 0 top
R15120  10K  [0201]  116.79,73.81 0 top
R15121  10K  [0201]  116.79,74.42 0 top
R15122  10K  [0201]  116.79,75.03 0 top
R15123  10K  [0201]  116.79,75.64 0 top
R15124  10K  [0201]  116.79,76.25 0 top
R15125  10K  [0201]  116.79,76.86 0 top
R15126  10K  [0201]  116.79,77.47 0 top
R15127  10K  [0201]  116.79,78.08 0 top
R15128  10K  [0201]  116.79,78.69 0 top
R15129  10K  [0201]  116.79,79.3 0 top
R15130  10K  [0201]  116.79,79.91 0 top
R15131  10K  [0201]  116.79,80.52 0 top
R15132  10K  [0201]  116.79,81.13 0 top
R15133  10K  [0201]  116.79,81.74 0 top
R15134  10K  [0201]  116.79,82.35 0 top
R15135  10K  [0201]  116.79,82.96 0 top
R15136  10K  [0201]  116.79,83.57 0 top
R15137  10K  [0201]  116.79,84.18 0 top
R15138  10K  [0201]  116.79,84.79 0 top
R15139  10K  [0201]  116.79,85.39 0 top
R15140  10K  [0201]  116.79,86 0 top
R15141  10K  [0201]  116.79,86.61 0 top
R15142  10K  [0201]  116.79,87.22 0 top
R15143  10K  [0201]  116.79,87.83 0 top
R15144  10K  [0201]  116.79,88.44 0 top
R15145  10K  [0201]  116.79,89.05 0 top
R15146  10K  [0201]  116.79,89.66 0 top
R15147  10K  [0201]  116.79,90.27 0 top
R15148  10K  [0201]  116.79,90.88 0 top
R15149  10K  [0201]  116.79,91.49 0 top
R15150  10K  [0201]  116.79,92.1 0 top
R15151  10K  [0201]  116.79,92.71 0 top
R15152  10K  [0201]  116.79,93.32 0 top
R15153  10K  [0201]  116.79,93.93 0 top
R15154  10K  [0201]  116.79,94.54 0 top
R15155  10K  [0201]  116.79,95.15 0 top
R15156  10K  [0201]  116.79,95.76 0 top
R15157  10K  [0201]  116.79,96.37 0 top
R15158  10K  [0201]  116.79,96.98 0 top
R15159  10K  [0201]  116.79,97.59 0 top
R15160  10K  [0201]  116.79,98.2 0 top
R15161  10K  [0201]  116.79,98.81 0 top
R15162  10K  [0201]  116.79,99.42 0 top
R15163  10K  [0201]  116.79,100.03 0 top
R15164  10K  [0201]  116.79,100.63 0 top
R15165  10K  [0201]  116.79,101.24 0 top
R15166  10K  [0201]  116.79,101.85 0 top
R15167  10K  [0201]  116.79,102.46 0 top
R15168  10K  [0201]  116.79,103.07 0 top
R15169  10K  [0201]  116.79,103.68 0 top
R15170  10K  [0201]  116.79,104.29 0 top
R15171  10K  [0201]  116.79,104.9 0 top
R15172  10K  [0201]  116.79,105.51 0 top
R15173  10K  [0201]  116.79,106.12 0 top
R15174  10K  [0201]  116.79,106.73 0 top
R15175  10K  [0201]  116.79,107.34 0 top
R15176  10K  [0201]  116.79,107.95 0 top
R15177  10K  [0201]  116.79,108.56 0 top
R15178  10K  [0201]  116.79,109.17 0 top
R15179  10K  [0201]  116.79,109.78 0 top
R15180  10K  [0201]  116.79,110.39 0 top
R15181  10K  [0201]  116.79,111 0 top
R15182  10K  [0201]  116.79,111.61 0 top
R15183  10K  [0201]  116.79,112.22 0 top
R15184  10K  [0201]  116.79,112.83 0 top
R15185  10K  [0201]  116.79,113.44 0 top
R15186  10K  [0201]  116.79,114.05 0 top
R15187  10K  [0201]  116.79,114.66 0 top
R15188  10K  [0201]  116.79,115.27 0 top
R15189  10K  [0201]  116.79,115.87 0 top
R15190  10K  [0201]  116.79,116.48 0 top
R15191  10K  [0201]  116.79,117.09 0 top
R15192  10K  [0201]  116.79,117.7 0 top
R15193  10K  [0201]  116.79,118.31 0 top
R15194  10K  [0201]  116.79,118.92 0 top
R15195  10K  [0201]  116.79,119.53 0 top
R15196  10K  [0201]  116.79,120.14 0 top
R15197  10K  [0201]  116.79,120.75 0 top
R15198  10K  [0201]  116.79,121.36 0 top
R15199  10K  [0201]  116.79,121.97 0 top
R15200  10K  [0201]  116.79,122.58 0 top
R15201  10K  [0201]  118.01,1.27 0 top
R15202  10K  [0201]  118.01,1.88 0 top
R15203  10K  [0201]  118.01,2.49 0 top
R15204  10K  [0201]  118.01,3.1 0 top
R15205  10K  [0201]  118.01,3.71 0 top
R15206  10K  [0201]  118.01,4.32 0 top
R15207  10K  [0201]  118.01,4.93 0 top
R15208  10K  [0201]  118.01,5.54 0 top
R15209  10K  [0201]  118.01,6.15 0 top
R15210  10K  [0201]  118.01,6.76 0 top
R15211  10K  [0201]  118.01,7.37 0 top
R15212  10K  [0201]  118.01,7.98 0 top
R15213  10K  [0201]  118.01,8.59 0 top
R15214  10K  [0201]  118.01,9.19 0 top
R15215  10K  [0201]  118.01,9.8 0 top
R15216  10K  [0201]  118.01,10.41 0 top
R15217  10K  [0201]  118.01,11.02 0 top
R15218  10K  [0201]  118.01,11.63 0 top
R15219  10K  [0201]  118.01,12.24 0 top
R15220  10K  [0201]  118.01,12.85 0 top
R15221  10K  [0201]  118.01,13.46 0 top
R15222  10K  [0201]  118.01,14.07 0 top
R15223  10K  [0201]  118.01,14.68 0 top
R15224  10K  [0201]  118.01,15.29 0 top
R15225  10K  [0201]  118.01,15.9 0 top
R15226  10K  [0201]  118.01,16.51 0 top
R15227  10K  [0201]  118.01,17.12 0 top
R15228  10K  [0201]  118.01,17.73 0 top
R15229  10K  [0201]  118.01,18.34 0 top
R15230  10K  [0201]  118.01,18.95 0 top
R15231  10K  [0201]  118.01,19.56 0 top
R15232  10K  [0201]  118.01,20.17 0 top
R15233  10K  [0201]  118.01,20.78 0 top
R15234  10K  [0201]  118.01,21.39 0 top
R15235  10K  [0201]  118.01,22 0 top
R15236  10K  [0201]  118.01,22.61 0 top
R15237  10K  [0201]  118.01,23.22 0 top
R15238  10K  [0201]  118.01,23.83 0 top
R15239  10K  [0201]  118.01,24.43 0 top
R15240  10K  [0201]  118.01,25.04 0 top
R15241  10K  [0201]  118.01,25.65 0 top
R15242  10K  [0201]  118.01,26.26 0 top
R15243  10K  [0201]  118.01,26.87 0 top
R15244  10K  [0201]  118.01,27.48 0 top
R15245  10K  [0201]  118.01,28.09 0 top
R15246  10K  [0201]  118.01,28.7 0 top
R15247  10K  [0201]  118.01,29.31 0 top
R15248  10K  [0201]  118.01,29.92 0 top
R15249  10K  [0201]  118.01,30.53 0 top
R15250  10K  [0201]  118.01,31.14 0 top
R15251  10K  [0201]  118.01,31.75 0 top
R15252  10K  [0201]  118.01,32.36 0 top
R15253  10K  [0201]  118.01,32.97 0 top
R15254  10K  [0201]  118.01,33.58 0 top
R15255  10K  [0201]  118.01,34.19 0 top
R15256  10K  [0201]  118.01,34.8 0 top
R15257  10K  [0201]  118.01,35.41 0 top
R15258  10K  [0201]  118.01,36.02 0 top
R15259  10K  [0201]  118.01,36.63 0 top
R15260  10K  [0201]  118.01,37.24 0 top
R15261  10K  [0201]  118.01,37.85 0 top
R15262  10K  [0201]  118.01,38.46 0 top
R15263  10K  [0201]  118.01,39.07 0 top
R15264  10K  [0201]  118.01,39.67 0 top
R15265  10K  [0201]  118.01,40.28 0 top
R15266  10K  [0201]  118.01,40.89 0 top
R15267  10K  [0201]  118.01,41.5 0 top
R15268  10K  [0201]  118.01,42.11 0 top
R15269  10K  [0201]  118.01,42.72 0 top
R15270  10K  [0201]  118.01,43.33 0 top
R15271  10K  [0201]  118.01,43.94 0 top
R15272  10K  [0201]  118.01,44.55 0 top
R15273  10K  [0201]  118.01,45.16 0 top
R15274  10K  [0201]  118.01,45.77 0 top
R15275  10K  [0201]  118.01,46.38 0 top
R15276  10K  [0201]  118.01,46.99 0 top
R15277  10K  [0201]  118.01,47.6 0 top
R15278  10K  [0201]  118.01,48.21 0 top
R15279  10K  [0201]  118.01,48.82 0 top
R15280  10K  [0201]  118.01,49.43 0 top
R15281  10K  [0201]  118.01,50.04 0 top
R15282  10K  [0201]  118.01,50.65 0 top
R15283  10K  [0201]  118.01,51.26 0 top
R15284  10K  [0201]  118.01,51.87 0 top
R15285  10K  [0201]  118.01,52.48 0 top
R15286  10K  [0201]  118.01,53.09 0 top
R15287  10K  [0201]  118.01,53.7 0 top
R15288  10K  [0201]  118.01,54.31 0 top
R15289  10K  [0201]  118.01,54.91 0 top
R15290  10K  [0201]  118.01,55.52 0 top
R15291  10K  [0201]  118.01,56.13 0 top
R15292  10K  [0201]  118.01,56.74 0 top
R15293  10K  [0201]  118.01,57.35 0 top
R15294  10K  [0201]  118.01,57.96 0 top
R15295  10K  [0201]  118.01,58.57 0 top
R15296  10K  [0201]  118.01,59.18 0 top
R15297  10K  [0201]  118.01,59.79 0 top
R15298  10K  [0201]  118.01,60.4 0 top
R15299  10K  [0201]  118.01,61.01 0 top
R15300  10K  [0201]  118.01,61.62 0 top
R15301  10K  [0201]  118.01,62.23 0 top
R15302  10K  [0201]  118.01,62.84 0 top
R15303  10K  [0201]  118.01,63.45 0 top
R15304  10K  [0201]  118.01,64.06 0 top
R15305  10K  [0201]  118.01,64.67 0 top
R15306  10K  [0201]  118.01,65.28 0 top
R15307  10K  [0201]  118.01,65.89 0 top
R15308  10K  [0201]  118.01,66.5 0 top
R15309  10K  [0201]  118.01,67.11 0 top
R15310  10K  [0201]  118.01,67.72 0 top
R15311  10K  [0201]  118.01,68.33 0 top
R15312  10K  [0201]  118.01,68.94 0 top
R15313  10K  [0201]  118.01,69.55 0 top
R15314  10K  [0201]  118.01,70.15 0 top
R15315  10K  [0201]  118.01,70.76 0 top
R15316  10K  [0201]  118.01,71.37 0 top
R15317  10K  [0201]  118.01,71.98 0 top
R15318  10K  [0201]  118.01,72.59 0 top
R15319  10K  [0201]  118.01,73.2 0 top
R15320  10K  [0201]  118.01,73.81 0 top
R15321  10K  [0201]  118.01,74.42 0 top
R15322  10K  [0201]  118.01,75.03 0 top
R15323  10K  [0201]  118.01,75.64 0 top
R15324  10K  [0201]  118.01,76.25 0 top
R15325  10K  [0201]  118.01,76.86 0 top
R15326  10K  [0201]  118.01,77.47 0 top
R15327  10K  [0201]  118.01,78.08 0 top
R15328  10K  [0201]  118.01,78.69 0 top
R15329  10K  [0201]  118.01,79.3 0 top
R15330  10K  [0201]  118.01,79.91 0 top
R15331  10K  [0201]  118.01,80.52 0 top
R15332  10K  [0201]  118.01,81.13 0 top
R15333  10K  [0201]  118.01,81.74 0 top
R15334  10K  [0201]  118.01,82.35 0 top
R15335  10K  [0201]  118.01,82.96 0 top
R15336  10K  [0201]  118.01,83.57 0 top
R15337  10K  [0201]  118.01,84.18 0 top
R15338  10K  [0201]  118.01,84.79 0 top
R15339  10K  [0201]  118.01,85.39 0 top
R15340  10K  [0201]  118.01,86 0 top
R15341  10K  [0201]  118.01,86.61 0 top
R15342  10K  [0201]  118.01,87.22 0 top
R15343  10K  [0201]  118.01,87.83 0 top
R15344  10K  [0201]  118.01,88.44 0 top
R15345  10K  [0201]  118.01,89.05 0 top
R15346  10K  [0201]  118.01,89.66 0 top
R15347  10K  [0201]  118.01,90.27 0 top
R15348  10K  [0201]  118.01,90.88 0 top
R15349  10K  [0201]  118.01,91.49 0 top
R15350  10K  [0201]  118.01,92.1 0 top
R15351  10K  [0201]  118.01,92.71 0 top
R15352  10K  [0201]  118.01,93.32 0 top
R15353  10K  [0201]  118.01,93.93 0 top
R15354  10K  [0201]  118.01,94.54 0 top
R15355  10K  [0201]  118.01,95.15 0 top
R15356  10K  [0201]  118.01,95.76 0 top
R15357  10K  [0201]  118.01,96.37 0 top
R15358  10K  [0201]  118.01,96.98 0 top
R15359  10K  [0201]  118.01,97.59 0 top
R15360  10K  [0201]  118.01,98.2 0 top
R15361  10K  [0201]  118.01,98.81 0 top
R15362  10K  [0201]  118.01,99.42 0 top
R15363  10K  [0201]  118.01,100.03 0 top
R15364  10K  [0201]  118.01,100.63 0 top
R15365  10K  [0201]  118.01,101.24 0 top
R15366  10K  [0201]  118.01,101.85 0 top
R15367  10K  [0201]  118.01,102.46 0 top
R15368  10K  [0201]  118.01,103.07 0 top
R15369  10K  [0201]  118.01,103.68 0 top
R15370  10K  [0201]  118.01,104.29 0 top
R15371  10K  [0201]  118.01,104.9 0 top
R15372  10K  [0201]  118.01,105.51 0 top
R15373  10K  [0201]  118.01,106.12 0 top
R15374  10K  [0201]  118.01,106.73 0 top
R15375  10K  [0201]  118.01,107.34 0 top
R15376  10K  [0201]  118.01,107.95 0 top
R15377  10K  [0201]  118.01,108.56 0 top
R15378  10K  [0201]  118.01,109.17 0 top
R15379  10K  [0201]  118.01,109.78 0 top
R15380  10K  [0201]  118.01,110.39 0 top
R15381  10K  [0201]  118.01,111 0 top
R15382  10K  [0201]  118.01,111.61 0 top
R15383  10K  [0201]  118.01,112.22 0 top
R15384  10K  [0201]  118.01,112.83 0 top
R15385  10K  [0201]  118.01,113.44 0 top
R15386  10K  [0201]  118.01,114.05 0 top
R15387  10K  [0201]  118.01,114.66 0 top
R15388  10K  [0201]  118.01,115.27 0 top
R15389  10K  [0201]  118.01,115.87 0 top
R15390  10K  [0201]  118.01,116.48 0 top
R15391  10K  [0201]  118.01,117.09 0 top
R15392  10K  [0201]  118.01,117.7 0 top
R15393  10K  [0201]  118.01,118.31 0 top
R15394  10K  [0201]  118.01,118.92 0 top
R15395  10K  [0201]  118.01,119.53 0 top
R15396  10K  [0201]  118.01,120.14 0 top
R15397  10K  [0201]  118.01,120.75 0 top
R15398  10K  [0201]  118.01,121.36 0 top
R15399  10K  [0201]  118.01,121.97 0 top
R15400  10K  [0201]  118.01,122.58 0 top
R15401  10K  [0201]  119.23,1.27 0 top
R15402  10K  [0201]  119.23,1.88 0 top
R15403  10K  [0201]  119.23,2.49 0 top
R15404  10K  [0201]  119.23,3.1 0 top
R15405  10K  [0201]  119.23,3.71 0 top
R15406  10K  [0201]  119.23,4.32 0 top
R15407  10K  [0201]  119.23,4.93 0 top
R15408  10K  [0201]  119.23,5.54 0 top
R15409  10K  [0201]  119.23,6.15 0 top
R15410  10K  [0201]  119.23,6.76 0 top
R15411  10K  [0201]  119.23,7.37 0 top
R15412  10K  [0201]  119.23,7.98 0 top
R15413  10K  [0201]  119.23,8.59 0 top
R15414  10K  [0201]  119.23,9.19 0 top
R15415  10K  [0201]  119.23,9.8 0 top
R15416  10K  [0201]  119.23,10.41 0 top
R15417  10K  [0201]  119.23,11.02 0 top
R15418  10K  [0201]  119.23,11.63 0 top
R15419  10K  [0201]  119.23,12.24 0 top
R15420  10K  [0201]  119.23,12.85 0 top
R15421  10K  [0201]  119.23,13.46 0 top
R15422  10K  [0201]  119.23,14.07 0 top
R15423  10K  [0201]  119.23,14.68 0 top
R15424  10K  [0201]  119.23,15.29 0 top
R15425  10K  [0201]  119.23,15.9 0 top
R15426  10K  [0201]  119.23,16.51 0 top
R15427  10K  [0201]  119.23,17.12 0 top
R15428  10K  [0201]  119.23,17.73 0 top
R15429  10K  [0201]  119.23,18.34 0 top
R15430  10K  [0201]  119.23,18.95 0 top
R15431  10K  [0201]  119.23,19.56 0 top
R15432  10K  [0201]  119.23,20.17 0 top
R15433  10K  [0201]  119.23,20.78 0 top
R15434  10K  [0201]  119.23,21.39 0 top
R15435  10K  [0201]  119.23,22 0 top
R15436  10K  [0201]  119.23,22.61 0 top
R15437  10K  [0201]  119.23,23.22 0 top
R15438  10K  [0201]  119.23,23.83 0 top
R15439  10K  [0201]  119.23,24.43 0 top
R15440  10K  [0201]  119.23,25.04 0 top
R15441  10K  [0201]  119.23,25.65 0 top
R15442  10K  [0201]  119.23,26.26 0 top
R15443  10K  [0201]  119.23,26.87 0 top
R15444  10K  [0201]  119.23,27.48 0 top
R15445  10K  [0201]  119.23,28.09 0 top
R15446  10K  [0201]  119.23,28.7 0 top
R15447  10K  [0201]  119.23,29.31 0 top
R15448  10K  [0201]  119.23,29.92 0 top
R15449  10K  [0201]  119.23,30.53 0 top
R15450  10K  [0201]  119.23,31.14 0 top
R15451  10K  [0201]  119.23,31.75 0 top
R15452  10K  [0201]  119.23,32.36 0 top
R15453  10K  [0201]  119.23,32.97 0 top
R15454  10K  [0201]  119.23,33.58 0 top
R15455  10K  [0201]  119.23,34.19 0 top
R15456  10K  [0201]  119.23,34.8 0 top
R15457  10K  [0201]  119.23,35.41 0 top
R15458  10K  [0201]  119.23,36.02 0 top
R15459  10K  [0201]  119.23,36.63 0 top
R15460  10K  [0201]  119.23,37.24 0 top
R15461  10K  [0201]  119.23,37.85 0 top
R15462  10K  [0201]  119.23,38.46 0 top
R15463  10K  [0201]  119.23,39.07 0 top
R15464  10K  [0201]  119.23,39.67 0 top
R15465  10K  [0201]  119.23,40.28 0 top
R15466  10K  [0201]  119.23,40.89 0 top
R15467  10K  [0201]  119.23,41.5 0 top
R15468  10K  [0201]  119.23,42.11 0 top
R15469  10K  [0201]  119.23,42.72 0 top
R15470  10K  [0201]  119.23,43.33 0 top
R15471  10K  [0201]  119.23,43.94 0 top
R15472  10K  [0201]  119.23,44.55 0 top
R15473  10K  [0201]  119.23,45.16 0 top
R15474  10K  [0201]  119.23,45.77 0 top
R15475  10K  [0201]  119.23,46.38 0 top
R15476  10K  [0201]  119.23,46.99 0 top
R15477  10K  [0201]  119.23,47.6 0 top
R15478  10K  [0201]  119.23,48.21 0 top
R15479  10K  [0201]  119.23,48.82 0 top
R15480  10K  [0201]  119.23,49.43 0 top
R15481  10K  [0201]  119.23,50.04 0 top
R15482  10K  [0201]  119.23,50.65 0 top
R15483  10K  [0201]  119.23,51.26 0 top
R15484  10K  [0201]  119.23,51.87 0 top
R15485  10K  [0201]  119.23,52.48 0 top
R15486  10K  [0201]  119.23,53.09 0 top
R15487  10K  [0201]  119.23,53.7 0 top
R15488  10K  [0201]  119.23,54.31 0 top
R15489  10K  [0201]  119.23,54.91 0 top
R15490  10K  [0201]  119.23,55.52 0 top
R15491  10K  [0201]  119.23,56.13 0 top
R15492  10K  [0201]  119.23,56.74 0 top
R15493  10K  [0201]  119.23,57.35 0 top
R15494  10K  [0201]  119.23,57.96 0 top
R15495  10K  [0201]  119.23,58.57 0 top
R15496  10K  [0201]  119.23,59.18 0 top
R15497  10K  [0201]  119.23,59.79 0 top
R15498  10K  [0201]  119.23,60.4 0 top